# EasyEDA Pro project Example_3D Shell Design.eprj, board 3D Shell Example-B
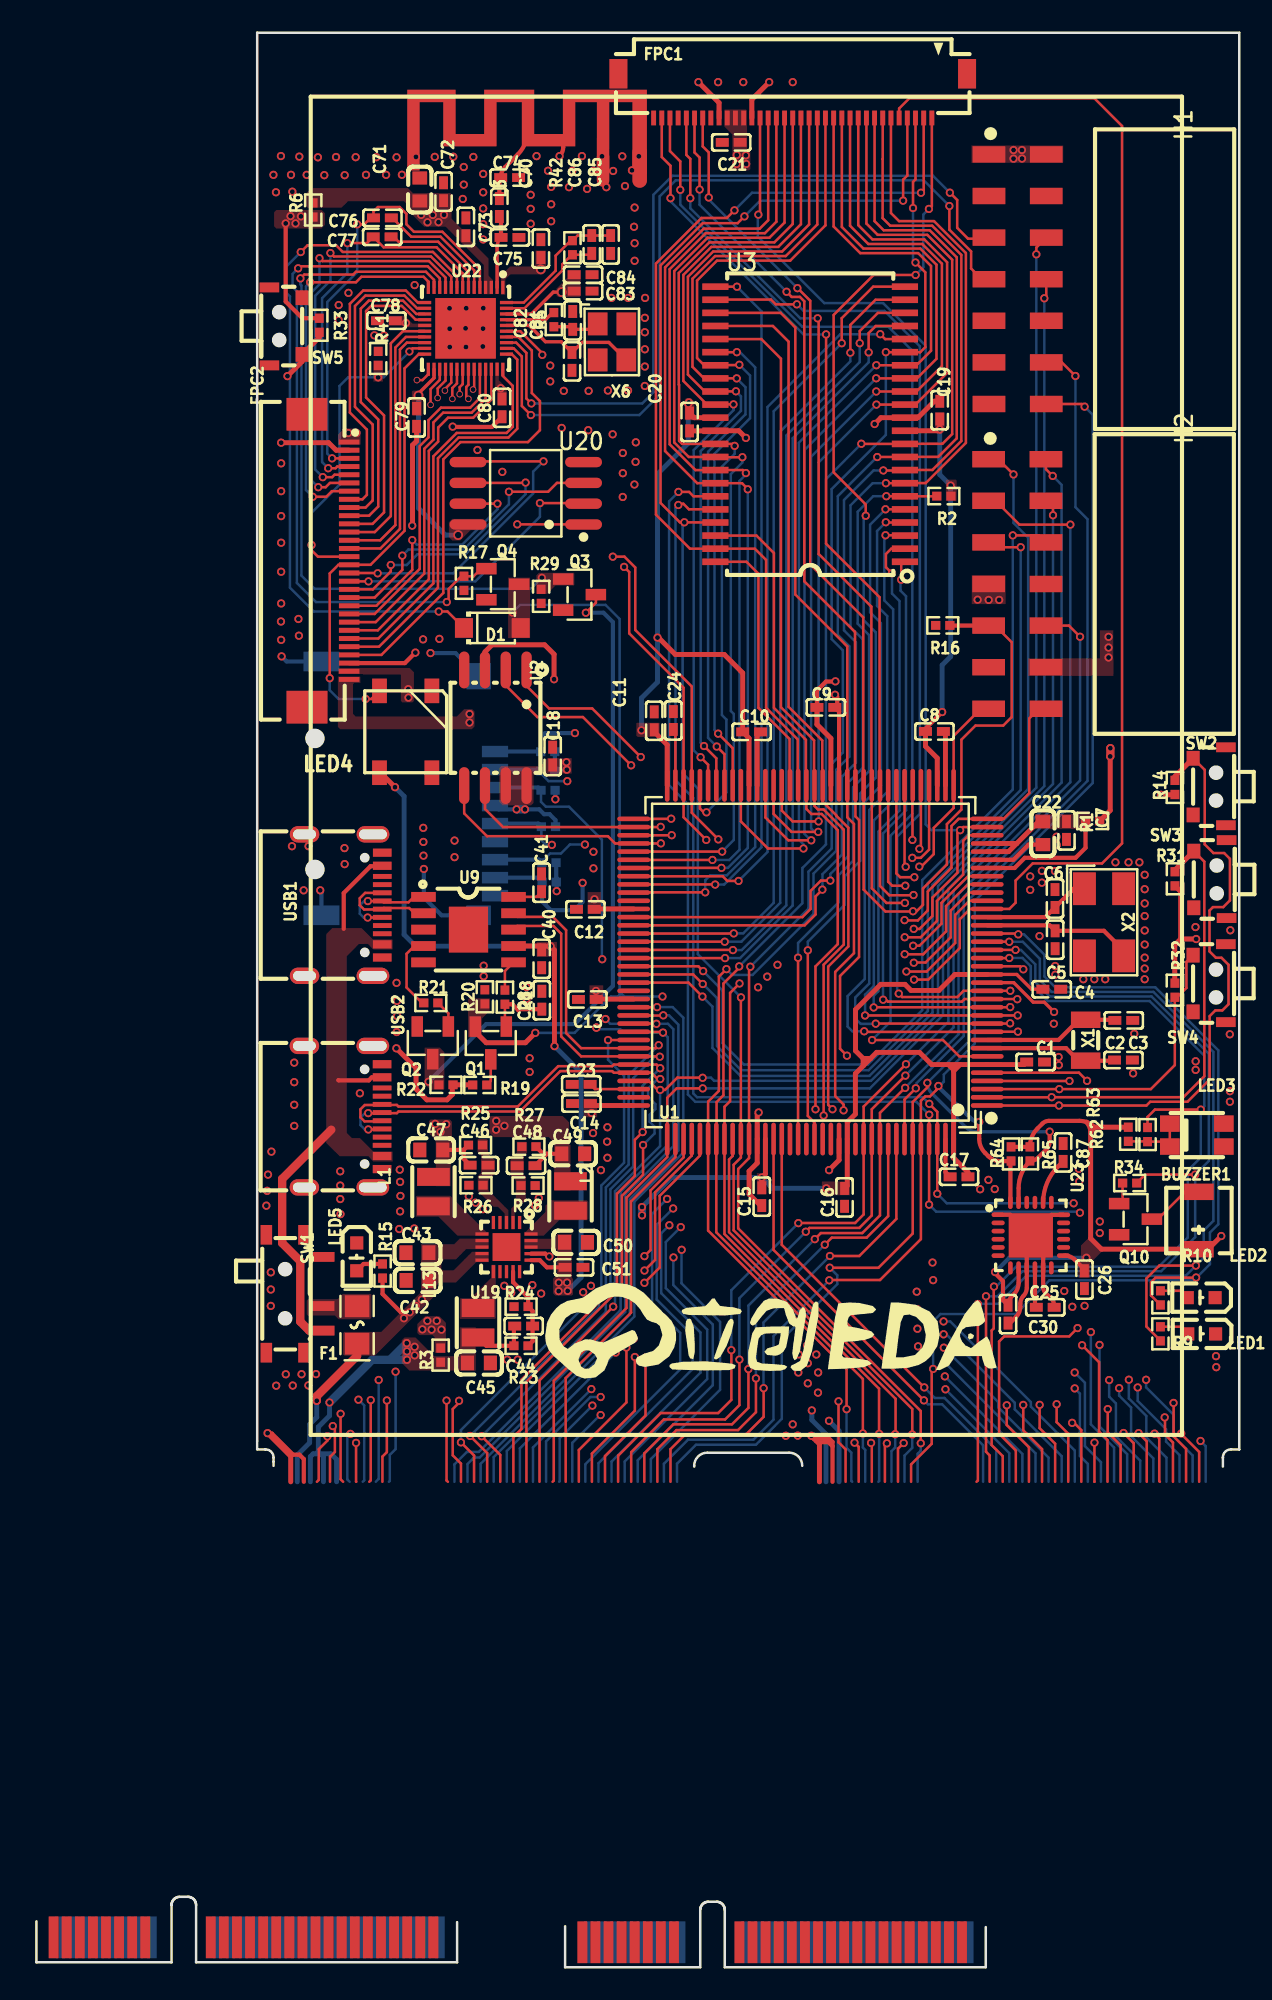
[diagram p0: board, top side]
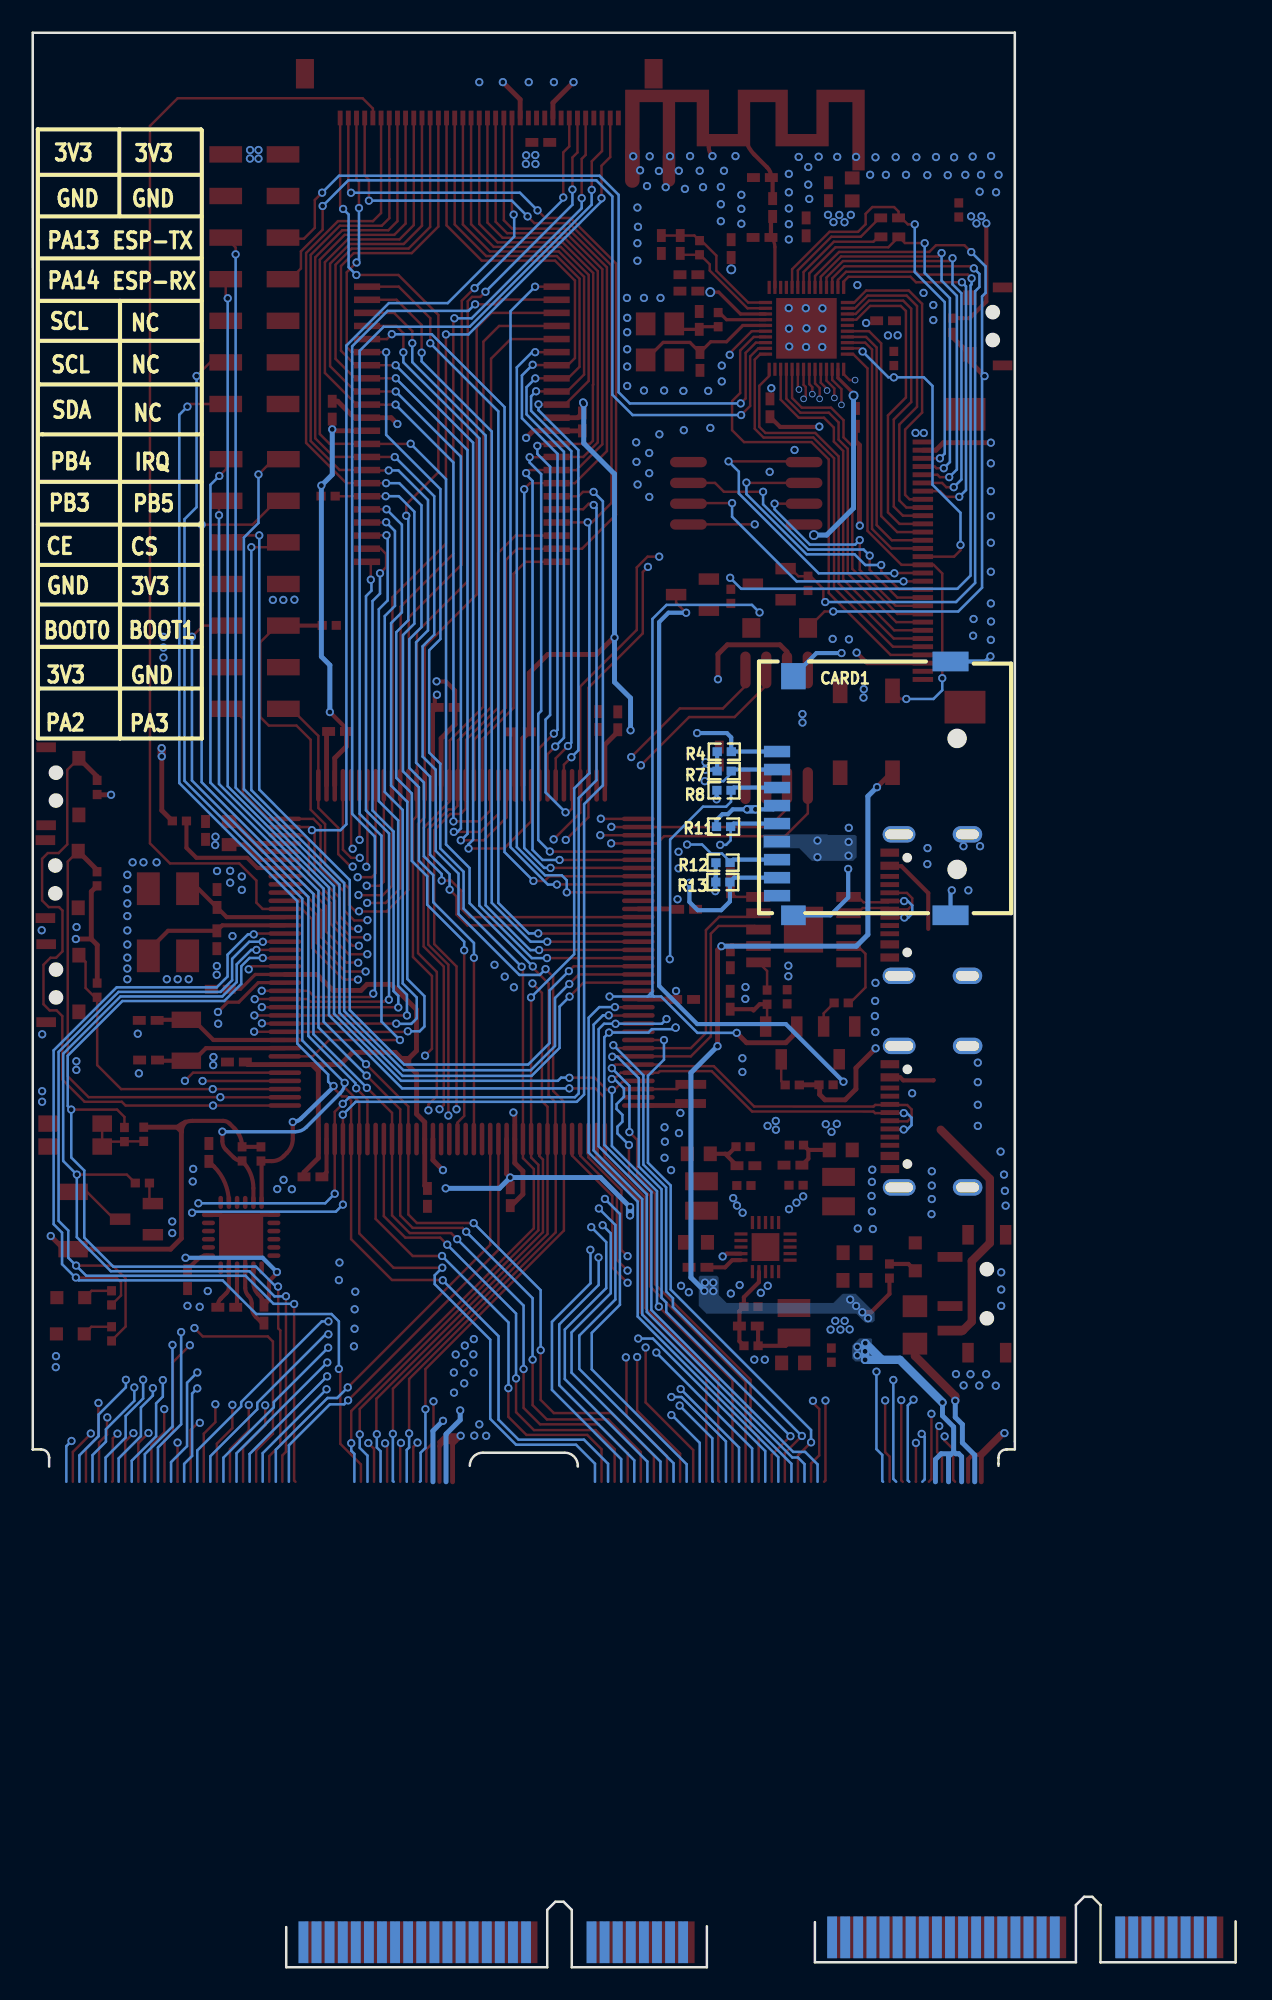
[diagram p1: board, bottom side, seen from below]

Outline 73.49 x 118.12 mm; copper layers: Top Layer, Inner1, Inner2, Bottom Layer. Coordinates in mm from the lower left corner of the outline.
Outline path: 14.49,30.62 14.49,31.12 arc(14.34,31.48) 13.99,31.62 13.99,31.62 13.49,31.62 13.49,118.12 73.49,118.12 73.48,31.62 73.48,31.62 72.99,31.62 arc(72.63,31.48) 72.49,31.12 72.49,30.57 ; 40.19,30.57 40.19,30.62 arc(40.42,31.19) 40.99,31.42 45.98,31.42 arc(46.55,31.19) 46.79,30.62
Stack: Top Layer 0.035mm / 介电1 0.48mm PP er 4.5 / Inner1 0.035mm / 介电2 0.48mm FR4 er 4.5 / Inner2 0.035mm / 介电3 0.48mm PP er 4.5 / Bottom Layer 0.035mm

## Design rules (mm)
spacing Common: track to track 0.152, other pairs 0.152 to 0.3
spacing 安全间距 (default): track to track 0.127, other pairs 0.127 to 0.3
track width Common: min 0.127, default 0.254, max 2.54
track width 导线 (default): min 0.127, default 0.254, max 5
differential pair Common (default): width min 0.127, default 0.254, max 2.54; gap min 0.152, default 0.152
via Common: diameter min 0.5, default 0.61, max 10; hole min 0.3, default 0.305, max 6
via 过孔尺寸 (default): diameter min 0.4, default 0.5, max 10; hole min 0.3, default 0.3, max 6

## Placement (name value [footprint] x y rotation side)
BUZZER1  4000Hz  [buz-smd_l4.0-w4.0-p3.50-l]  71.02 45.59 90 top
C1  100nF  [c0402]  61.04 55.27 180 top
C2  10pF  [c0402]  66.43 57.81 0 top
C3  10pF  [c0402]  66.41 55.39 0 top
C4  100nF  [c0402]  62.03 59.71 180 top
C5  22pF  [c0402]  62.24 62.74 90 top
C6  22pF  [c0402]  62.23 65.26 270 top
C7  100nF  [c0402]  62.93 69.41 270 top
C8  100nF  [c0402]  54.86 75.45 180 top
C9  100nF  [c0402]  48.23 76.92 180 top
C10  100nF  [c0402]  43.69 75.43 180 top
C11  100nF  [c0402]  37.74 76.11 270 top
C12  100nF  [c0402]  33.54 64.6 180 top
C13  100nF  [c0402]  33.66 59.09 180 top
C14  100nF  [c0402]  33.3 52.74 180 top
C15  100nF  [c0402]  44.31 47.05 270 top
C16  100nF  [c0402]  49.37 47.01 270 top
C17  100nF  [c0402]  56.37 48.26 180 top
C18  100nF  [c0402]  31.54 73.95 90 top
C19  100nF  [c0402]  55.19 95.07 270 top
C20  100nF  [c0402]  39.91 94.35 270 top
C21  100nF  [c0402]  42.45 111.42 0 top
C22  10uF  [c0603]  61.49 69.25 90 top
C23  2.2uF  [c0402]  33.28 53.91 180 top
C24  2.2uF  [c0402]  38.91 76.12 270 top
C25  100nF  [c0402]  61.63 40.3 0 top
C26  100nF  [c0402]  64.03 41.98 90 top
C28  100nf  [c0402]  30.88 59.04 270 top
C30  10nF  [c0402]  59.36 39.88 270 top
C40  1uF  [c0402]  30.87 61.58 90 top
C41  100nF  [c0402]  30.86 66.22 270 top
C42  10uF  [c0603]  23.29 41.94 180 top
C43  10uF  [c0603]  23.28 43.63 180 top
C44  220pF  [c0402]  29.77 39.15 0 top
C45  10uF  [c0603]  27.03 36.9 180 top
C46  220pF  [c0402]  27.04 48.97 0 top
C47  10uF  [c0603]  24.12 49.9 0 top
C48  220pF  [c0402]  29.91 48.94 0 top
C49  10uF  [c0603]  32.79 49.67 0 top
C50  10uF  [c0603]  32.97 44.26 180 top
C51  1uF  [c0402]  32.84 42.74 180 top
C70  100nF  [c0402]  30.82 104.94 270 top
C71  10uF  [c0603]  23.42 108.55 90 top
C72  1uF  [c0402]  24.87 108.41 270 top
C73  100nF  [c0402]  26.24 106.27 270 top
C74  TBD  [c0402]  28.91 109.27 0 top
C75  TBD  [c0402]  28.93 105.62 0 top
C76  270pF(NC)  [c0402]  21.14 106.81 180 top
C77  270pF(NC)  [c0402]  21.12 105.65 0 top
C78  100nF  [c0402]  21.38 100.53 0 top
C79  4.7uF  [c0402]  23.23 94.63 90 top
C80  100nF  [c0402]  28.45 95.22 90 top
C81  22pF  [c0402]  32.72 98.05 90 top
C82  22pF  [c0402]  32.77 100.55 270 top
C83  1uF  [c0402]  33.4 102.34 180 top
C84  100pF  [c0402]  33.4 103.34 180 top
C85  3.3nF  [c0402]  33.93 105.19 90 top
C86  10nF  [c0402]  35.08 105.19 270 top
C87  2.2nF  [c0402]  62.72 49.75 90 top
CARD1  -  [tf-smd_xktf-n02-n]  22.71 71.98 90 bottom
D1  -  [sod-123_l2.7-w1.6-ls3.8-rd]  27.85 81.77 0 top
F1  -  [f0805]  19.59 39.22 270 top
FPC1  -  [fpc-smd_f0502-b-35-15t-r]  46.21 114.26 180 top
FPC2  -  [fpc-smd_30p-p0.50_xunpu_fpc-05f-30ph20]  17.82 85.88 270 top
H1  -  [hdr-smd_14p-p2.54-h-f-r2-c7-s3.50]  59.94 103.07 270 top
H2  -  [hdr-smd_14p-p2.54-h-f-r2-c7-s3.50]  59.92 84.46 270 top
L1  1.5uH  [ind-smd_l2.5-w2.0_252012]  24.26 47.36 270 top
L2  1.5uH  [ind-smd_l2.5-w2.0_252012]  32.63 47.09 270 top
L3  TBD  [l0402]  28.28 107.45 270 top
L13  1.5uH  [ind-smd_l2.5-w2.0_252012]  26.98 39.35 270 top
LED1  -  [led0603-r-rd]  71.19 38.67 180 top
LED2  -  [led0603-r-rd]  71.16 40.88 180 top
LED3  -  [led-smd_4p-l3.2-w2.7-r-rd]  70.89 50.81 0 top
LED4  WS2812B  [ws2812b]  22.56 75.43 90 top
LED5  -  [led0603-r-rd]  19.57 43.38 270 top
Q1  -  [sot-23-3_l2.9-w1.3-p1.90-ls2.4-br]  27.76 56.43 90 top
Q2  -  [sot-23-3_l2.9-w1.3-p1.90-ls2.4-br]  24.22 56.44 90 top
Q3  -  [sot-23-3_l2.9-w1.3-p1.90-ls2.4-br]  33.18 83.81 180 top
Q4  -  [sot-23-3_l2.9-w1.3-p1.90-ls2.4-br]  28.49 84.45 180 top
Q10  -  [sot-23-3_l2.9-w1.3-p1.90-ls2.4-br]  67.15 45.68 180 top
R1  10Ω  [r0402]  64.53 69.99 180 top
R2  10kΩ  [r0402]  55.44 89.82 180 top
R3  0Ω  [r0402]  24.7 37.37 90 top
R4  10kΩ  [r0402]  31.24 74.22 180 bottom
R5  0Ω  [r0402]  31.61 100.6 270 top
R6  0Ω  [r0402]  16.91 107.3 90 top
R7  10kΩ  [r0402]  31.24 73.04 180 bottom
R8  10kΩ  [r0402]  31.26 71.86 180 bottom
R9  4.7kΩ  [r0402]  68.67 38.67 90 top
R10  4.7kΩ  [r0402]  68.67 40.87 90 top
R11  10kΩ  [r0402]  31.28 69.64 180 bottom
R12  10kΩ  [r0402]  31.31 67.44 180 bottom
R13  10kΩ  [r0402]  31.32 66.26 180 bottom
R14  10kΩ  [r0402]  69.55 72.04 270 top
R15  4.7kΩ  [r0402]  21.15 42.51 90 top
R16  10kΩ  [r0402]  55.37 81.93 0 top
R17  10kΩ  [r0402]  26.12 84.5 90 top
R18  10kΩ  [r0402]  28.62 59.23 270 top
R19  1kΩ  [r0402]  27.09 53.87 180 top
R20  10kΩ  [r0402]  27.4 59.25 270 top
R21  10kΩ  [r0402]  24.1 58.88 180 top
R22  10kΩ  [r0402]  25.02 53.88 0 top
R23  68kΩ  [r0402]  29.6 37.94 0 top
R24  15kΩ  [r0402]  29.61 40.34 180 top
R25  110K  [r0402]  26.83 50.2 0 top
R26  30kΩ  [r0402]  26.85 47.75 0 top
R27  100kΩ  [r0402]  30.09 50.1 0 top
R28  100kΩ  [r0402]  30.04 47.73 0 top
R29  10kΩ  [r0402]  30.84 83.7 90 top
R31  10kΩ  [r0402]  69.56 66.46 270 top
R32  10kΩ  [r0402]  69.55 59.66 90 top
R33  10kΩ  [r0402]  17.28 100.26 90 top
R34  1kΩ  [r0402]  66.79 47.88 180 top
R41  0Ω(NC)  [r0402]  20.88 98.23 270 top
R42  20kΩ  [r0402]  32.75 104.99 90 top
R62  47kΩ  [r0402]  66.71 50.86 90 top
R63  1kΩ  [r0402]  67.88 50.84 270 top
R64  4.7kΩ  [r0402]  59.54 49.66 90 top
R65  4.7kΩ  [r0402]  60.7 49.66 90 top
SW1  -  [sw-th_msk12c02]  15.75 41.12 270 top
SW2  -  [key-smd_k2-1806sa-axxw-xx]  71.67 72.11 270 top
SW3  -  [key-smd_k2-1806sa-axxw-xx]  71.71 66.44 270 top
SW4  -  [key-smd_k2-1806sa-axxw-xx]  71.67 60.09 270 top
SW5  -  [key-smd_k2-1806sa-axxw-xx]  15.23 100.19 90 top
U1  -  [lqfp-144_l20.0-w20.0-p0.50-ls22.0-bl]  47.29 61.37 90 top
U2  -  [soic-8_l5.2-w5.2-p1.27-ls7.9-bl]  28.04 75.68 180 top
U3  IS62WV51216  [tsopii-44_l18.4-w10.2-p0.80-ls11.8-bl]  47.27 94.21 90 top
U4  -  [mini-pcie 0.8-52p]  46.79 28.22 0 top
U5  -  [mini-pcie 0.8-52p]  14.49 28.52 0 top
U9  -  [esop-10_l4.9-w3.9-p1.00-ls6.2-bl-ep]  26.4 63.36 270 top
U19  -  [wqfn-20_l3.0-w3.0-p0.40-bl-ep]  28.72 43.97 180 top
U20  -  [soic-8_l5.3-w5.3-p1.27-ls8.0-bl]  29.9 90 90 top
U22  -  [qfn-48_l5.0-w5.0-p0.35-bl-ep3.7]  26.22 100.07 180 top
U23  -  [qfn-24_l4.0-w4.0-p0.50-bl-ep2.7]  60.75 44.7 270 top
U24  -  [tan]  29.99 111.72 0 top
USB1  -  [usb-c-smd_type-c-31-m-31]  18.76 64.85 270 top
USB2  -  [usb-c-smd_type-c-31-m-31]  18.75 51.94 270 top
X1  32.768kHz  [fc-135r_l3.2-w1.5]  64.1 56.6 90 top
X2  8MHz  [osc-smd_4p-l5.0-w3.2-bl]  65.22 63.8 270 top
X6  40MHZ±10ppm  [osc-smd_4p-l3.2-w2.5-bl]  35.16 99.24 270 top

## Footprints (pads in the part's own frame, mm; a bottom-side part is the same pattern mirrored in y, then rotated)
buz-smd_l4.0-w4.0-p3.50-l
  rect 1.001x1.801 smd: 1(-1.75,0) 2(1.75,0)
c0402
  rect 0.79x0.541 smd: 1(-0.546,0) 2(0.546,0)
c0603
  rect 0.8x0.899 smd: 1(-0.701,0) 2(0.701,0)
esop-10_l4.9-w3.9-p1.00-ls6.2-bl-ep
  rect 0.6x1.501 smd: 1(-1.999,-2.751) 2(-1.001,-2.751) 3(0,-2.751) 4(1.001,-2.751) 5(1.999,-2.751) 6(1.999,2.751) 7(1.001,2.751) 8(0,2.751) 9(-1.001,2.751) 10(-1.999,2.751)
  rect 2.799x2.401 smd: 11(0,0)
f0805
  rect 1.336x1.501 smd: 1(-1.143,0) 2(1.143,0)
fc-135r_l3.2-w1.5
  rect 1.001x1.801 smd: 1(-1.25,0) 2(1.25,0)
fpc-smd_30p-p0.50_xunpu_fpc-05f-30ph20
  rect 0.299x1.25 smd: 1(-7.249,1.288) 2(-6.749,1.288) 3(-6.251,1.288) 4(-5.75,1.288) 5(-5.25,1.288) 6(-4.75,1.288) 7(-4.25,1.288) 8(-3.749,1.288) 9(-3.248,1.288) 10(-2.751,1.288) 11(-2.251,1.288) 12(-1.75,1.288) 13(-1.25,1.288) 14(-0.75,1.288) 15(-0.249,1.288) 16(0.249,1.288) 17(0.75,1.288) 18(1.25,1.288) 19(1.75,1.288) 20(2.251,1.288) 21(2.751,1.288) 22(3.251,1.288) 23(3.749,1.288) 24(4.25,1.288) 25(4.75,1.288) 26(5.25,1.288) 27(5.75,1.288) 28(6.251,1.288) 29(6.752,1.288) 30(7.249,1.288)
  rect 1.999x2.499 smd: 31(8.941,-1.288) 32(-8.941,-1.288)
fpc-smd_f0502-b-35-15t-r
  rect 0.299x0.899 smd: 1(-8.499,1.351) 2(-8.001,1.351) 3(-7.5,1.351) 4(-7,1.351) 5(-6.5,1.351) 6(-6,1.351) 7(-5.499,1.351) 8(-4.998,1.351) 9(-4.501,1.351) 10(-4,1.351) 11(-3.5,1.351) 12(-2.999,1.351) 13(-2.499,1.351) 14(-1.999,1.351) 15(-1.501,1.351) 16(-1.001,1.351) 17(-0.5,1.351) 18(0,1.351) 19(0.5,1.351) 20(1.001,1.351) 21(1.501,1.351) 22(1.999,1.351) 23(2.499,1.351) 24(2.999,1.351) 25(3.5,1.351) 26(4,1.351) 27(4.501,1.351) 28(5.002,1.351) 29(5.499,1.351) 30(6,1.351) 31(6.5,1.351) 32(7,1.351) 33(7.5,1.351) 34(8.001,1.351) 35(8.499,1.351)
  rect 1.1x1.801 smd: 36(10.65,-1.349) 37(-10.65,-1.349)
hdr-smd_14p-p2.54-h-f-r2-c7-s3.50
  rect 1.001x1.999 smd: 1(-7.62,-1.75) 2(-7.62,1.75) 3(-5.08,-1.75) 4(-5.08,1.75) 5(-2.54,-1.75) 6(-2.54,1.75) 7(0,-1.75) 8(0,1.75) 9(2.54,-1.75) 10(2.54,1.75) 11(5.08,-1.75) 12(5.08,1.75) 13(7.62,-1.75) 14(7.62,1.75)
ind-smd_l2.5-w2.0_252012
  rect 1.1x1.999 smd: 1(-0.899,0) 2(0.899,0)
key-smd_k2-1806sa-axxw-xx
  rect 0.899x0.8 smd: 1(-1.71,-1.001) 2(1.75,-1.001)
  rect 0.6x1.199 smd: 3(-2.38,1.001) 4(2.38,1.001)
l0402
  rect 0.79x0.541 smd: 1(-0.546,0) 2(0.546,0)
led0603-r-rd
  rect 0.8x0.8 smd: 1(0.851,0) 2(-0.851,0)
led-smd_4p-l3.2-w2.7-r-rd
  rect 1.199x1.001 smd: 1(1.651,0.701) 1(1.651,-0.701) 2(-1.651,0.701) 2(-1.651,-0.701)
lqfp-144_l20.0-w20.0-p0.50-ls22.0-bl
  oval 0.28x1.999 smd: 1(-8.751,-10.8) 2(-8.25,-10.8) 3(-7.75,-10.8) 4(-7.249,-10.8) 5(-6.749,-10.8) 6(-6.251,-10.8) 7(-5.75,-10.8) 8(-5.25,-10.8) 9(-4.75,-10.8) 10(-4.25,-10.8) 11(-3.749,-10.8) 12(-3.251,-10.8) 13(-2.751,-10.8) 14(-2.251,-10.8) 15(-1.75,-10.8) 16(-1.25,-10.8) 17(-0.75,-10.8) 18(-0.249,-10.8) 19(0.249,-10.8) 20(0.75,-10.8) 21(1.25,-10.8) 22(1.75,-10.8) 23(2.251,-10.8) 24(2.751,-10.8) 25(3.251,-10.8) 26(3.749,-10.8) 27(4.25,-10.8) 28(4.75,-10.8) 29(5.25,-10.8) 30(5.75,-10.8) 31(6.251,-10.8) 32(6.752,-10.8) 33(7.249,-10.8) 34(7.75,-10.8) 35(8.25,-10.8) 36(8.751,-10.8) 73(8.751,10.8) 74(8.25,10.8) 75(7.75,10.8) 76(7.249,10.8) 77(6.752,10.8) 78(6.251,10.8) 79(5.75,10.8) 80(5.25,10.8) 81(4.75,10.8) 82(4.25,10.8) 83(3.749,10.8) 84(3.251,10.8) 85(2.751,10.8) 86(2.251,10.8) 87(1.75,10.8) 88(1.25,10.8) 89(0.75,10.8) 90(0.249,10.8) 91(-0.249,10.8) 92(-0.75,10.8) 93(-1.25,10.8) 94(-1.75,10.8) 95(-2.251,10.8) 96(-2.751,10.8) 97(-3.251,10.8) 98(-3.749,10.8) 99(-4.25,10.8) 100(-4.75,10.8) 101(-5.25,10.8) 102(-5.75,10.8) 103(-6.251,10.8) 104(-6.749,10.8) 105(-7.249,10.8) 106(-7.75,10.8) 107(-8.25,10.8) 108(-8.751,10.8)
  oval 1.999x0.28 smd: 37(10.8,-8.751) 38(10.8,-8.25) 39(10.8,-7.75) 40(10.8,-7.249) 41(10.8,-6.749) 42(10.8,-6.251) 43(10.8,-5.75) 44(10.8,-5.25) 45(10.8,-4.75) 46(10.8,-4.25) 47(10.8,-3.749) 48(10.8,-3.251) 49(10.8,-2.751) 50(10.8,-2.251) 51(10.8,-1.75) 52(10.8,-1.25) 53(10.8,-0.75) 54(10.8,-0.249) 55(10.8,0.249) 56(10.8,0.75) 57(10.8,1.25) 58(10.8,1.75) 59(10.8,2.251) 60(10.8,2.751) 61(10.8,3.251) 62(10.8,3.749) 63(10.8,4.25) 64(10.8,4.75) 65(10.8,5.25) 66(10.8,5.75) 67(10.8,6.251) 68(10.8,6.749) 69(10.8,7.249) 70(10.8,7.75) 71(10.8,8.25) 72(10.8,8.751) 109(-10.8,8.751) 110(-10.8,8.25) 111(-10.8,7.75) 112(-10.8,7.249) 113(-10.8,6.749) 114(-10.8,6.251) 115(-10.8,5.75) 116(-10.8,5.25) 117(-10.8,4.75) 118(-10.8,4.25) 119(-10.8,3.749) 120(-10.8,3.251) 121(-10.8,2.751) 122(-10.8,2.251) 123(-10.8,1.75) 124(-10.8,1.25) 125(-10.8,0.75) 126(-10.8,0.249) 127(-10.8,-0.249) 128(-10.8,-0.75) 129(-10.8,-1.25) 130(-10.8,-1.75) 131(-10.8,-2.251) 132(-10.8,-2.751) 133(-10.8,-3.251) 134(-10.8,-3.749) 135(-10.8,-4.25) 136(-10.8,-4.75) 137(-10.8,-5.25) 138(-10.8,-5.75) 139(-10.8,-6.251) 140(-10.8,-6.749) 141(-10.8,-7.249) 142(-10.8,-7.75) 143(-10.8,-8.25) 144(-10.8,-8.751)
mini-pcie 0.8-52p
  rect 0.6x2.55 smd: 1(-13.437,-26.692) 3(-12.637,-26.692) 5(-11.837,-26.692) 7(-11.037,-26.692) 9(-10.237,-26.692) 11(-9.437,-26.692) 13(-8.637,-26.692) 15(-7.837,-26.692) 17(-3.837,-26.692) 19(-3.037,-26.692) 21(-2.237,-26.692) 23(-1.437,-26.692) 25(-0.637,-26.692) 27(0.163,-26.692) 29(0.963,-26.692) 31(1.763,-26.692) 33(2.563,-26.692) 35(3.363,-26.692) 37(4.163,-26.692) 39(4.963,-26.692) 41(5.763,-26.692) 43(6.563,-26.692) 45(7.363,-26.692) 47(8.163,-26.692) 49(8.963,-26.692) 51(9.763,-26.692)
  rect 0.6x2.55 smd far side: 2(-13.037,-26.692) 4(-12.237,-26.692) 6(-11.437,-26.692) 8(-10.637,-26.692) 10(-9.837,-26.692) 12(-9.037,-26.692) 14(-8.237,-26.692) 16(-7.437,-26.692) 18(-3.437,-26.692) 20(-2.637,-26.692) 22(-1.837,-26.692) 24(-1.037,-26.692) 26(-0.237,-26.692) 28(0.563,-26.692) 30(1.363,-26.692) 32(2.163,-26.692) 34(2.963,-26.692) 36(3.763,-26.692) 38(4.563,-26.692) 40(5.363,-26.692) 42(6.163,-26.692) 44(6.963,-26.692) 46(7.763,-26.692) 48(8.563,-26.692) 50(9.363,-26.692) 52(10.163,-26.692)
osc-smd_4p-l3.2-w2.5-bl
  rect 1.399x1.199 smd: 1(-1.1,-0.874) 2(1.1,-0.874) 3(1.1,0.876) 4(-1.1,0.876)
osc-smd_4p-l5.0-w3.2-bl
  rect 1.999x1.399 smd: 1(-2.05,-1.199) 2(2.05,-1.199) 3(2.05,1.199) 4(-2.05,1.199)
qfn-24_l4.0-w4.0-p0.50-bl-ep2.7
  oval 0.28x0.8 smd: 1(-1.25,-1.999) 2(-0.75,-1.999) 3(-0.249,-1.999) 4(0.249,-1.999) 5(0.75,-1.999) 6(1.25,-1.999) 13(1.25,1.999) 14(0.75,1.999) 15(0.249,1.999) 16(-0.249,1.999) 17(-0.75,1.999) 18(-1.242,1.999)
  oval 0.8x0.28 smd: 7(1.999,-1.25) 8(1.999,-0.75) 9(1.999,-0.249) 10(1.999,0.249) 11(1.999,0.75) 12(1.999,1.25) 19(-1.999,1.25) 20(-1.999,0.75) 21(-1.999,0.249) 22(-1.999,-0.249) 23(-1.999,-0.75) 24(-1.999,-1.25)
  rect 2.7x2.7 smd: 25(0.013,0)
qfn-48_l5.0-w5.0-p0.35-bl-ep3.7
  rect 0.201x0.8 smd: 1(-2.276,-2.499) 2(-1.925,-2.499) 3(-1.575,-2.499) 4(-1.224,-2.499) 5(-0.876,-2.499) 6(-0.526,-2.499) 7(-0.175,-2.499) 8(0.175,-2.499) 9(0.526,-2.499) 10(0.874,-2.499) 11(1.224,-2.499) 12(1.575,-2.499) 13(1.925,-2.499) 14(2.276,-2.499) 25(2.276,2.499) 26(1.925,2.499) 27(1.575,2.499) 28(1.224,2.499) 29(0.874,2.499) 30(0.526,2.499) 31(0.175,2.499) 32(-0.175,2.499) 33(-0.526,2.499) 34(-0.876,2.499) 35(-1.224,2.499) 36(-1.575,2.499) 37(-1.925,2.499) 38(-2.276,2.499)
  rect 0.8x0.201 smd: 15(2.499,-1.575) 16(2.499,-1.224) 17(2.499,-0.876) 18(2.499,-0.526) 19(2.499,-0.175) 20(2.499,0.175) 21(2.499,0.526) 22(2.499,0.874) 23(2.499,1.224) 24(2.499,1.575) 39(-2.499,1.575) 40(-2.499,1.224) 41(-2.499,0.874) 42(-2.499,0.526) 43(-2.499,0.175) 44(-2.499,-0.175) 45(-2.499,-0.526) 46(-2.499,-0.876) 47(-2.499,-1.224) 48(-2.499,-1.575)
  rect 3.701x3.701 smd: 49(0,0)
r0402
  rect 0.567x0.541 smd: 1(-0.432,0) 2(0.432,0)
sod-123_l2.7-w1.6-ls3.8-rd
  rect 1.1x1.199 smd: 1(-1.735,0) 2(1.735,0)
soic-8_l5.2-w5.2-p1.27-ls7.9-bl
  oval 0.63x2.251 smd: 1(-1.905,-3.53) 2(-0.635,-3.53) 3(0.635,-3.53) 4(1.905,-3.53) 5(1.905,3.53) 6(0.635,3.53) 7(-0.635,3.53) 8(-1.905,3.53)
soic-8_l5.3-w5.3-p1.27-ls8.0-bl
  oval 0.63x2.251 smd: 1(-1.905,-3.53) 2(-0.635,-3.53) 3(0.635,-3.53) 4(1.905,-3.53) 5(1.905,3.53) 6(0.635,3.53) 7(-0.635,3.53) 8(-1.905,3.53)
sot-23-3_l2.9-w1.3-p1.90-ls2.4-br
  rect 1.25x0.701 smd: 1(1.001,-0.95) 2(1.001,0.95) 3(-1.001,0)
sw-th_msk12c02
  rect 0.6x1.524 smd: 1(-2.251,1.7) 2(0.75,1.7) 3(2.251,1.7)
  rect 1.199x0.701 smd: 4(-3.599,0.6) 4(-3.599,-1.7) 4(3.599,0.6) 4(3.599,-1.7)
tan
  round 0.399 smd: 1(4.63,-2.621) 2(6.868,-2.621)
tf-smd_xktf-n02-n
  rect 0.701x1.6 smd: 1(2.251,5.301) 2(1.151,5.301) 3(0.051,5.301) 4(-1.049,5.301) 5(-2.149,5.301) 6(-3.251,5.301) 7(-4.351,5.301) 8(-5.451,5.301) 9(-6.551,5.301)
  rect 1.199x1.501 smd: 10(-7.75,4.3)
  rect 1.199x2.2 smd: 11(-7.75,-5.301) 13(7.75,-5.301)
  rect 1.6x1.501 smd: 12(6.851,4.3)
tsopii-44_l18.4-w10.2-p0.80-ls11.8-bl
  rect 0.399x1.6 smd: 1(-8.4,-5.791) 2(-7.599,-5.791) 3(-6.8,-5.791) 4(-6,-5.791) 5(-5.199,-5.791) 6(-4.399,-5.791) 7(-3.599,-5.791) 8(-2.799,-5.791) 9(-1.999,-5.791) 10(-1.202,-5.791) 11(-0.399,-5.791) 12(0.402,-5.791) 13(1.199,-5.791) 14(1.999,-5.791) 15(2.801,-5.791) 16(3.602,-5.791) 17(4.402,-5.791) 18(5.202,-5.791) 19(6,-5.791) 20(6.8,-5.791) 21(7.599,-5.791) 22(8.4,-5.791) 23(8.4,5.791) 24(7.599,5.791) 25(6.8,5.791) 26(6,5.791) 27(5.202,5.791) 28(4.402,5.791) 29(3.602,5.791) 30(2.801,5.791) 31(1.999,5.791) 32(1.199,5.791) 33(0.402,5.791) 34(-0.399,5.791) 35(-1.202,5.791) 36(-1.999,5.791) 37(-2.799,5.791) 38(-3.599,5.791) 39(-4.399,5.791) 40(-5.199,5.791) 41(-6,5.791) 42(-6.8,5.791) 43(-7.599,5.791) 44(-8.4,5.791)
usb-c-smd_type-c-31-m-31
  oval 1.001x1.999 hole 0.6x1.7: 1(-4.321,1.806) 1(4.321,1.806)
  oval 1.001x1.801 hole 0.6x1.399: 1(-4.321,-2.375) 1(4.321,-2.375)
  rect 0.5x1.141 smd: A1(-3.2,2.373) A4(-2.401,2.373) A9(2.401,2.373) A12(3.2,2.373)
  rect 0.299x1.141 smd: A5(-1.25,2.373) A6(-0.249,2.373) A7(0.249,2.373) A8(1.25,2.375) B5(1.75,2.373) B6(0.75,2.373) B7(-0.75,2.373) B8(-1.75,2.375)
wqfn-20_l3.0-w3.0-p0.40-bl-ep
  rect 0.201x0.8 smd: 1(-0.8,-1.498) 2(-0.402,-1.498) 3(0,-1.498) 4(0.399,-1.498) 5(0.8,-1.498) 11(0.8,1.501) 12(0.399,1.501) 13(0,1.501) 14(-0.402,1.501) 15(-0.8,1.501)
  rect 0.8x0.201 smd: 6(1.501,-0.8) 7(1.501,-0.399) 8(1.501,0) 9(1.501,0.399) 10(1.501,0.8) 16(-1.501,0.8) 17(-1.501,0.402) 18(-1.501,0) 19(-1.501,-0.399) 20(-1.501,-0.8)
  rect 1.7x1.7 smd: 21(0,0)
ws2812b
  rect 1.501x0.899 smd: 1(-2.499,1.6) 2(-2.499,-1.6) 3(2.499,-1.6) 4(2.499,1.6)
